# EAGLE board Resistor_Resistor (EAGLE 8.3.0), part 5 of 32
## Placement (x,y rotation side) (continued)
R5244  10K  [0201]  57.05,27.48 0 top
R5245  10K  [0201]  57.05,28.09 0 top
R5246  10K  [0201]  57.05,28.7 0 top
R5247  10K  [0201]  57.05,29.31 0 top
R5248  10K  [0201]  57.05,29.92 0 top
R5249  10K  [0201]  57.05,30.53 0 top
R5250  10K  [0201]  57.05,31.14 0 top
R5251  10K  [0201]  57.05,31.75 0 top
R5252  10K  [0201]  57.05,32.36 0 top
R5253  10K  [0201]  57.05,32.97 0 top
R5254  10K  [0201]  57.05,33.58 0 top
R5255  10K  [0201]  57.05,34.19 0 top
R5256  10K  [0201]  57.05,34.8 0 top
R5257  10K  [0201]  57.05,35.41 0 top
R5258  10K  [0201]  57.05,36.02 0 top
R5259  10K  [0201]  57.05,36.63 0 top
R5260  10K  [0201]  57.05,37.24 0 top
R5261  10K  [0201]  57.05,37.85 0 top
R5262  10K  [0201]  57.05,38.46 0 top
R5263  10K  [0201]  57.05,39.07 0 top
R5264  10K  [0201]  57.05,39.67 0 top
R5265  10K  [0201]  57.05,40.28 0 top
R5266  10K  [0201]  57.05,40.89 0 top
R5267  10K  [0201]  57.05,41.5 0 top
R5268  10K  [0201]  57.05,42.11 0 top
R5269  10K  [0201]  57.05,42.72 0 top
R5270  10K  [0201]  57.05,43.33 0 top
R5271  10K  [0201]  57.05,43.94 0 top
R5272  10K  [0201]  57.05,44.55 0 top
R5273  10K  [0201]  57.05,45.16 0 top
R5274  10K  [0201]  57.05,45.77 0 top
R5275  10K  [0201]  57.05,46.38 0 top
R5276  10K  [0201]  57.05,46.99 0 top
R5277  10K  [0201]  57.05,47.6 0 top
R5278  10K  [0201]  57.05,48.21 0 top
R5279  10K  [0201]  57.05,48.82 0 top
R5280  10K  [0201]  57.05,49.43 0 top
R5281  10K  [0201]  57.05,50.04 0 top
R5282  10K  [0201]  57.05,50.65 0 top
R5283  10K  [0201]  57.05,51.26 0 top
R5284  10K  [0201]  57.05,51.87 0 top
R5285  10K  [0201]  57.05,52.48 0 top
R5286  10K  [0201]  57.05,53.09 0 top
R5287  10K  [0201]  57.05,53.7 0 top
R5288  10K  [0201]  57.05,54.31 0 top
R5289  10K  [0201]  57.05,54.91 0 top
R5290  10K  [0201]  57.05,55.52 0 top
R5291  10K  [0201]  57.05,56.13 0 top
R5292  10K  [0201]  57.05,56.74 0 top
R5293  10K  [0201]  57.05,57.35 0 top
R5294  10K  [0201]  57.05,57.96 0 top
R5295  10K  [0201]  57.05,58.57 0 top
R5296  10K  [0201]  57.05,59.18 0 top
R5297  10K  [0201]  57.05,59.79 0 top
R5298  10K  [0201]  57.05,60.4 0 top
R5299  10K  [0201]  57.05,61.01 0 top
R5300  10K  [0201]  57.05,61.62 0 top
R5301  10K  [0201]  57.05,62.23 0 top
R5302  10K  [0201]  57.05,62.84 0 top
R5303  10K  [0201]  57.05,63.45 0 top
R5304  10K  [0201]  57.05,64.06 0 top
R5305  10K  [0201]  57.05,64.67 0 top
R5306  10K  [0201]  57.05,65.28 0 top
R5307  10K  [0201]  57.05,65.89 0 top
R5308  10K  [0201]  57.05,66.5 0 top
R5309  10K  [0201]  57.05,67.11 0 top
R5310  10K  [0201]  57.05,67.72 0 top
R5311  10K  [0201]  57.05,68.33 0 top
R5312  10K  [0201]  57.05,68.94 0 top
R5313  10K  [0201]  57.05,69.55 0 top
R5314  10K  [0201]  57.05,70.15 0 top
R5315  10K  [0201]  57.05,70.76 0 top
R5316  10K  [0201]  57.05,71.37 0 top
R5317  10K  [0201]  57.05,71.98 0 top
R5318  10K  [0201]  57.05,72.59 0 top
R5319  10K  [0201]  57.05,73.2 0 top
R5320  10K  [0201]  57.05,73.81 0 top
R5321  10K  [0201]  57.05,74.42 0 top
R5322  10K  [0201]  57.05,75.03 0 top
R5323  10K  [0201]  57.05,75.64 0 top
R5324  10K  [0201]  57.05,76.25 0 top
R5325  10K  [0201]  57.05,76.86 0 top
R5326  10K  [0201]  57.05,77.47 0 top
R5327  10K  [0201]  57.05,78.08 0 top
R5328  10K  [0201]  57.05,78.69 0 top
R5329  10K  [0201]  57.05,79.3 0 top
R5330  10K  [0201]  57.05,79.91 0 top
R5331  10K  [0201]  57.05,80.52 0 top
R5332  10K  [0201]  57.05,81.13 0 top
R5333  10K  [0201]  57.05,81.74 0 top
R5334  10K  [0201]  57.05,82.35 0 top
R5335  10K  [0201]  57.05,82.96 0 top
R5336  10K  [0201]  57.05,83.57 0 top
R5337  10K  [0201]  57.05,84.18 0 top
R5338  10K  [0201]  57.05,84.79 0 top
R5339  10K  [0201]  57.05,85.39 0 top
R5340  10K  [0201]  57.05,86 0 top
R5341  10K  [0201]  57.05,86.61 0 top
R5342  10K  [0201]  57.05,87.22 0 top
R5343  10K  [0201]  57.05,87.83 0 top
R5344  10K  [0201]  57.05,88.44 0 top
R5345  10K  [0201]  57.05,89.05 0 top
R5346  10K  [0201]  57.05,89.66 0 top
R5347  10K  [0201]  57.05,90.27 0 top
R5348  10K  [0201]  57.05,90.88 0 top
R5349  10K  [0201]  57.05,91.49 0 top
R5350  10K  [0201]  57.05,92.1 0 top
R5351  10K  [0201]  57.05,92.71 0 top
R5352  10K  [0201]  57.05,93.32 0 top
R5353  10K  [0201]  57.05,93.93 0 top
R5354  10K  [0201]  57.05,94.54 0 top
R5355  10K  [0201]  57.05,95.15 0 top
R5356  10K  [0201]  57.05,95.76 0 top
R5357  10K  [0201]  57.05,96.37 0 top
R5358  10K  [0201]  57.05,96.98 0 top
R5359  10K  [0201]  57.05,97.59 0 top
R5360  10K  [0201]  57.05,98.2 0 top
R5361  10K  [0201]  57.05,98.81 0 top
R5362  10K  [0201]  57.05,99.42 0 top
R5363  10K  [0201]  57.05,100.03 0 top
R5364  10K  [0201]  57.05,100.63 0 top
R5365  10K  [0201]  57.05,101.24 0 top
R5366  10K  [0201]  57.05,101.85 0 top
R5367  10K  [0201]  57.05,102.46 0 top
R5368  10K  [0201]  57.05,103.07 0 top
R5369  10K  [0201]  57.05,103.68 0 top
R5370  10K  [0201]  57.05,104.29 0 top
R5371  10K  [0201]  57.05,104.9 0 top
R5372  10K  [0201]  57.05,105.51 0 top
R5373  10K  [0201]  57.05,106.12 0 top
R5374  10K  [0201]  57.05,106.73 0 top
R5375  10K  [0201]  57.05,107.34 0 top
R5376  10K  [0201]  57.05,107.95 0 top
R5377  10K  [0201]  57.05,108.56 0 top
R5378  10K  [0201]  57.05,109.17 0 top
R5379  10K  [0201]  57.05,109.78 0 top
R5380  10K  [0201]  57.05,110.39 0 top
R5381  10K  [0201]  57.05,111 0 top
R5382  10K  [0201]  57.05,111.61 0 top
R5383  10K  [0201]  57.05,112.22 0 top
R5384  10K  [0201]  57.05,112.83 0 top
R5385  10K  [0201]  57.05,113.44 0 top
R5386  10K  [0201]  57.05,114.05 0 top
R5387  10K  [0201]  57.05,114.66 0 top
R5388  10K  [0201]  57.05,115.27 0 top
R5389  10K  [0201]  57.05,115.87 0 top
R5390  10K  [0201]  57.05,116.48 0 top
R5391  10K  [0201]  57.05,117.09 0 top
R5392  10K  [0201]  57.05,117.7 0 top
R5393  10K  [0201]  57.05,118.31 0 top
R5394  10K  [0201]  57.05,118.92 0 top
R5395  10K  [0201]  57.05,119.53 0 top
R5396  10K  [0201]  57.05,120.14 0 top
R5397  10K  [0201]  57.05,120.75 0 top
R5398  10K  [0201]  57.05,121.36 0 top
R5399  10K  [0201]  57.05,121.97 0 top
R5400  10K  [0201]  57.05,122.58 0 top
R5401  10K  [0201]  58.27,1.27 0 top
R5402  10K  [0201]  58.27,1.88 0 top
R5403  10K  [0201]  58.27,2.49 0 top
R5404  10K  [0201]  58.27,3.1 0 top
R5405  10K  [0201]  58.27,3.71 0 top
R5406  10K  [0201]  58.27,4.32 0 top
R5407  10K  [0201]  58.27,4.93 0 top
R5408  10K  [0201]  58.27,5.54 0 top
R5409  10K  [0201]  58.27,6.15 0 top
R5410  10K  [0201]  58.27,6.76 0 top
R5411  10K  [0201]  58.27,7.37 0 top
R5412  10K  [0201]  58.27,7.98 0 top
R5413  10K  [0201]  58.27,8.59 0 top
R5414  10K  [0201]  58.27,9.19 0 top
R5415  10K  [0201]  58.27,9.8 0 top
R5416  10K  [0201]  58.27,10.41 0 top
R5417  10K  [0201]  58.27,11.02 0 top
R5418  10K  [0201]  58.27,11.63 0 top
R5419  10K  [0201]  58.27,12.24 0 top
R5420  10K  [0201]  58.27,12.85 0 top
R5421  10K  [0201]  58.27,13.46 0 top
R5422  10K  [0201]  58.27,14.07 0 top
R5423  10K  [0201]  58.27,14.68 0 top
R5424  10K  [0201]  58.27,15.29 0 top
R5425  10K  [0201]  58.27,15.9 0 top
R5426  10K  [0201]  58.27,16.51 0 top
R5427  10K  [0201]  58.27,17.12 0 top
R5428  10K  [0201]  58.27,17.73 0 top
R5429  10K  [0201]  58.27,18.34 0 top
R5430  10K  [0201]  58.27,18.95 0 top
R5431  10K  [0201]  58.27,19.56 0 top
R5432  10K  [0201]  58.27,20.17 0 top
R5433  10K  [0201]  58.27,20.78 0 top
R5434  10K  [0201]  58.27,21.39 0 top
R5435  10K  [0201]  58.27,22 0 top
R5436  10K  [0201]  58.27,22.61 0 top
R5437  10K  [0201]  58.27,23.22 0 top
R5438  10K  [0201]  58.27,23.83 0 top
R5439  10K  [0201]  58.27,24.43 0 top
R5440  10K  [0201]  58.27,25.04 0 top
R5441  10K  [0201]  58.27,25.65 0 top
R5442  10K  [0201]  58.27,26.26 0 top
R5443  10K  [0201]  58.27,26.87 0 top
R5444  10K  [0201]  58.27,27.48 0 top
R5445  10K  [0201]  58.27,28.09 0 top
R5446  10K  [0201]  58.27,28.7 0 top
R5447  10K  [0201]  58.27,29.31 0 top
R5448  10K  [0201]  58.27,29.92 0 top
R5449  10K  [0201]  58.27,30.53 0 top
R5450  10K  [0201]  58.27,31.14 0 top
R5451  10K  [0201]  58.27,31.75 0 top
R5452  10K  [0201]  58.27,32.36 0 top
R5453  10K  [0201]  58.27,32.97 0 top
R5454  10K  [0201]  58.27,33.58 0 top
R5455  10K  [0201]  58.27,34.19 0 top
R5456  10K  [0201]  58.27,34.8 0 top
R5457  10K  [0201]  58.27,35.41 0 top
R5458  10K  [0201]  58.27,36.02 0 top
R5459  10K  [0201]  58.27,36.63 0 top
R5460  10K  [0201]  58.27,37.24 0 top
R5461  10K  [0201]  58.27,37.85 0 top
R5462  10K  [0201]  58.27,38.46 0 top
R5463  10K  [0201]  58.27,39.07 0 top
R5464  10K  [0201]  58.27,39.67 0 top
R5465  10K  [0201]  58.27,40.28 0 top
R5466  10K  [0201]  58.27,40.89 0 top
R5467  10K  [0201]  58.27,41.5 0 top
R5468  10K  [0201]  58.27,42.11 0 top
R5469  10K  [0201]  58.27,42.72 0 top
R5470  10K  [0201]  58.27,43.33 0 top
R5471  10K  [0201]  58.27,43.94 0 top
R5472  10K  [0201]  58.27,44.55 0 top
R5473  10K  [0201]  58.27,45.16 0 top
R5474  10K  [0201]  58.27,45.77 0 top
R5475  10K  [0201]  58.27,46.38 0 top
R5476  10K  [0201]  58.27,46.99 0 top
R5477  10K  [0201]  58.27,47.6 0 top
R5478  10K  [0201]  58.27,48.21 0 top
R5479  10K  [0201]  58.27,48.82 0 top
R5480  10K  [0201]  58.27,49.43 0 top
R5481  10K  [0201]  58.27,50.04 0 top
R5482  10K  [0201]  58.27,50.65 0 top
R5483  10K  [0201]  58.27,51.26 0 top
R5484  10K  [0201]  58.27,51.87 0 top
R5485  10K  [0201]  58.27,52.48 0 top
R5486  10K  [0201]  58.27,53.09 0 top
R5487  10K  [0201]  58.27,53.7 0 top
R5488  10K  [0201]  58.27,54.31 0 top
R5489  10K  [0201]  58.27,54.91 0 top
R5490  10K  [0201]  58.27,55.52 0 top
R5491  10K  [0201]  58.27,56.13 0 top
R5492  10K  [0201]  58.27,56.74 0 top
R5493  10K  [0201]  58.27,57.35 0 top
R5494  10K  [0201]  58.27,57.96 0 top
R5495  10K  [0201]  58.27,58.57 0 top
R5496  10K  [0201]  58.27,59.18 0 top
R5497  10K  [0201]  58.27,59.79 0 top
R5498  10K  [0201]  58.27,60.4 0 top
R5499  10K  [0201]  58.27,61.01 0 top
R5500  10K  [0201]  58.27,61.62 0 top
R5501  10K  [0201]  58.27,62.23 0 top
R5502  10K  [0201]  58.27,62.84 0 top
R5503  10K  [0201]  58.27,63.45 0 top
R5504  10K  [0201]  58.27,64.06 0 top
R5505  10K  [0201]  58.27,64.67 0 top
R5506  10K  [0201]  58.27,65.28 0 top
R5507  10K  [0201]  58.27,65.89 0 top
R5508  10K  [0201]  58.27,66.5 0 top
R5509  10K  [0201]  58.27,67.11 0 top
R5510  10K  [0201]  58.27,67.72 0 top
R5511  10K  [0201]  58.27,68.33 0 top
R5512  10K  [0201]  58.27,68.94 0 top
R5513  10K  [0201]  58.27,69.55 0 top
R5514  10K  [0201]  58.27,70.15 0 top
R5515  10K  [0201]  58.27,70.76 0 top
R5516  10K  [0201]  58.27,71.37 0 top
R5517  10K  [0201]  58.27,71.98 0 top
R5518  10K  [0201]  58.27,72.59 0 top
R5519  10K  [0201]  58.27,73.2 0 top
R5520  10K  [0201]  58.27,73.81 0 top
R5521  10K  [0201]  58.27,74.42 0 top
R5522  10K  [0201]  58.27,75.03 0 top
R5523  10K  [0201]  58.27,75.64 0 top
R5524  10K  [0201]  58.27,76.25 0 top
R5525  10K  [0201]  58.27,76.86 0 top
R5526  10K  [0201]  58.27,77.47 0 top
R5527  10K  [0201]  58.27,78.08 0 top
R5528  10K  [0201]  58.27,78.69 0 top
R5529  10K  [0201]  58.27,79.3 0 top
R5530  10K  [0201]  58.27,79.91 0 top
R5531  10K  [0201]  58.27,80.52 0 top
R5532  10K  [0201]  58.27,81.13 0 top
R5533  10K  [0201]  58.27,81.74 0 top
R5534  10K  [0201]  58.27,82.35 0 top
R5535  10K  [0201]  58.27,82.96 0 top
R5536  10K  [0201]  58.27,83.57 0 top
R5537  10K  [0201]  58.27,84.18 0 top
R5538  10K  [0201]  58.27,84.79 0 top
R5539  10K  [0201]  58.27,85.39 0 top
R5540  10K  [0201]  58.27,86 0 top
R5541  10K  [0201]  58.27,86.61 0 top
R5542  10K  [0201]  58.27,87.22 0 top
R5543  10K  [0201]  58.27,87.83 0 top
R5544  10K  [0201]  58.27,88.44 0 top
R5545  10K  [0201]  58.27,89.05 0 top
R5546  10K  [0201]  58.27,89.66 0 top
R5547  10K  [0201]  58.27,90.27 0 top
R5548  10K  [0201]  58.27,90.88 0 top
R5549  10K  [0201]  58.27,91.49 0 top
R5550  10K  [0201]  58.27,92.1 0 top
R5551  10K  [0201]  58.27,92.71 0 top
R5552  10K  [0201]  58.27,93.32 0 top
R5553  10K  [0201]  58.27,93.93 0 top
R5554  10K  [0201]  58.27,94.54 0 top
R5555  10K  [0201]  58.27,95.15 0 top
R5556  10K  [0201]  58.27,95.76 0 top
R5557  10K  [0201]  58.27,96.37 0 top
R5558  10K  [0201]  58.27,96.98 0 top
R5559  10K  [0201]  58.27,97.59 0 top
R5560  10K  [0201]  58.27,98.2 0 top
R5561  10K  [0201]  58.27,98.81 0 top
R5562  10K  [0201]  58.27,99.42 0 top
R5563  10K  [0201]  58.27,100.03 0 top
R5564  10K  [0201]  58.27,100.63 0 top
R5565  10K  [0201]  58.27,101.24 0 top
R5566  10K  [0201]  58.27,101.85 0 top
R5567  10K  [0201]  58.27,102.46 0 top
R5568  10K  [0201]  58.27,103.07 0 top
R5569  10K  [0201]  58.27,103.68 0 top
R5570  10K  [0201]  58.27,104.29 0 top
R5571  10K  [0201]  58.27,104.9 0 top
R5572  10K  [0201]  58.27,105.51 0 top
R5573  10K  [0201]  58.27,106.12 0 top
R5574  10K  [0201]  58.27,106.73 0 top
R5575  10K  [0201]  58.27,107.34 0 top
R5576  10K  [0201]  58.27,107.95 0 top
R5577  10K  [0201]  58.27,108.56 0 top
R5578  10K  [0201]  58.27,109.17 0 top
R5579  10K  [0201]  58.27,109.78 0 top
R5580  10K  [0201]  58.27,110.39 0 top
R5581  10K  [0201]  58.27,111 0 top
R5582  10K  [0201]  58.27,111.61 0 top
R5583  10K  [0201]  58.27,112.22 0 top
R5584  10K  [0201]  58.27,112.83 0 top
R5585  10K  [0201]  58.27,113.44 0 top
R5586  10K  [0201]  58.27,114.05 0 top
R5587  10K  [0201]  58.27,114.66 0 top
R5588  10K  [0201]  58.27,115.27 0 top
R5589  10K  [0201]  58.27,115.87 0 top
R5590  10K  [0201]  58.27,116.48 0 top
R5591  10K  [0201]  58.27,117.09 0 top
R5592  10K  [0201]  58.27,117.7 0 top
R5593  10K  [0201]  58.27,118.31 0 top
R5594  10K  [0201]  58.27,118.92 0 top
R5595  10K  [0201]  58.27,119.53 0 top
R5596  10K  [0201]  58.27,120.14 0 top
R5597  10K  [0201]  58.27,120.75 0 top
R5598  10K  [0201]  58.27,121.36 0 top
R5599  10K  [0201]  58.27,121.97 0 top
R5600  10K  [0201]  58.27,122.58 0 top
R5601  10K  [0201]  59.49,1.27 0 top
R5602  10K  [0201]  59.49,1.88 0 top
R5603  10K  [0201]  59.49,2.49 0 top
R5604  10K  [0201]  59.49,3.1 0 top
R5605  10K  [0201]  59.49,3.71 0 top
R5606  10K  [0201]  59.49,4.32 0 top
R5607  10K  [0201]  59.49,4.93 0 top
R5608  10K  [0201]  59.49,5.54 0 top
R5609  10K  [0201]  59.49,6.15 0 top
R5610  10K  [0201]  59.49,6.76 0 top
R5611  10K  [0201]  59.49,7.37 0 top
R5612  10K  [0201]  59.49,7.98 0 top
R5613  10K  [0201]  59.49,8.59 0 top
R5614  10K  [0201]  59.49,9.19 0 top
R5615  10K  [0201]  59.49,9.8 0 top
R5616  10K  [0201]  59.49,10.41 0 top
R5617  10K  [0201]  59.49,11.02 0 top
R5618  10K  [0201]  59.49,11.63 0 top
R5619  10K  [0201]  59.49,12.24 0 top
R5620  10K  [0201]  59.49,12.85 0 top
R5621  10K  [0201]  59.49,13.46 0 top
R5622  10K  [0201]  59.49,14.07 0 top
R5623  10K  [0201]  59.49,14.68 0 top
R5624  10K  [0201]  59.49,15.29 0 top
R5625  10K  [0201]  59.49,15.9 0 top
R5626  10K  [0201]  59.49,16.51 0 top
R5627  10K  [0201]  59.49,17.12 0 top
R5628  10K  [0201]  59.49,17.73 0 top
R5629  10K  [0201]  59.49,18.34 0 top
R5630  10K  [0201]  59.49,18.95 0 top
R5631  10K  [0201]  59.49,19.56 0 top
R5632  10K  [0201]  59.49,20.17 0 top
R5633  10K  [0201]  59.49,20.78 0 top
R5634  10K  [0201]  59.49,21.39 0 top
R5635  10K  [0201]  59.49,22 0 top
R5636  10K  [0201]  59.49,22.61 0 top
R5637  10K  [0201]  59.49,23.22 0 top
R5638  10K  [0201]  59.49,23.83 0 top
R5639  10K  [0201]  59.49,24.43 0 top
R5640  10K  [0201]  59.49,25.04 0 top
R5641  10K  [0201]  59.49,25.65 0 top
R5642  10K  [0201]  59.49,26.26 0 top
R5643  10K  [0201]  59.49,26.87 0 top
R5644  10K  [0201]  59.49,27.48 0 top
R5645  10K  [0201]  59.49,28.09 0 top
R5646  10K  [0201]  59.49,28.7 0 top
R5647  10K  [0201]  59.49,29.31 0 top
R5648  10K  [0201]  59.49,29.92 0 top
R5649  10K  [0201]  59.49,30.53 0 top
R5650  10K  [0201]  59.49,31.14 0 top
R5651  10K  [0201]  59.49,31.75 0 top
R5652  10K  [0201]  59.49,32.36 0 top
R5653  10K  [0201]  59.49,32.97 0 top
R5654  10K  [0201]  59.49,33.58 0 top
R5655  10K  [0201]  59.49,34.19 0 top
R5656  10K  [0201]  59.49,34.8 0 top
R5657  10K  [0201]  59.49,35.41 0 top
R5658  10K  [0201]  59.49,36.02 0 top
R5659  10K  [0201]  59.49,36.63 0 top
R5660  10K  [0201]  59.49,37.24 0 top
R5661  10K  [0201]  59.49,37.85 0 top
R5662  10K  [0201]  59.49,38.46 0 top
R5663  10K  [0201]  59.49,39.07 0 top
R5664  10K  [0201]  59.49,39.67 0 top
R5665  10K  [0201]  59.49,40.28 0 top
R5666  10K  [0201]  59.49,40.89 0 top
R5667  10K  [0201]  59.49,41.5 0 top
R5668  10K  [0201]  59.49,42.11 0 top
R5669  10K  [0201]  59.49,42.72 0 top
R5670  10K  [0201]  59.49,43.33 0 top
R5671  10K  [0201]  59.49,43.94 0 top
R5672  10K  [0201]  59.49,44.55 0 top
R5673  10K  [0201]  59.49,45.16 0 top
R5674  10K  [0201]  59.49,45.77 0 top
R5675  10K  [0201]  59.49,46.38 0 top
R5676  10K  [0201]  59.49,46.99 0 top
R5677  10K  [0201]  59.49,47.6 0 top
R5678  10K  [0201]  59.49,48.21 0 top
R5679  10K  [0201]  59.49,48.82 0 top
R5680  10K  [0201]  59.49,49.43 0 top
R5681  10K  [0201]  59.49,50.04 0 top
R5682  10K  [0201]  59.49,50.65 0 top
R5683  10K  [0201]  59.49,51.26 0 top
R5684  10K  [0201]  59.49,51.87 0 top
R5685  10K  [0201]  59.49,52.48 0 top
R5686  10K  [0201]  59.49,53.09 0 top
R5687  10K  [0201]  59.49,53.7 0 top
R5688  10K  [0201]  59.49,54.31 0 top
R5689  10K  [0201]  59.49,54.91 0 top
R5690  10K  [0201]  59.49,55.52 0 top
R5691  10K  [0201]  59.49,56.13 0 top
R5692  10K  [0201]  59.49,56.74 0 top
R5693  10K  [0201]  59.49,57.35 0 top
R5694  10K  [0201]  59.49,57.96 0 top
R5695  10K  [0201]  59.49,58.57 0 top
R5696  10K  [0201]  59.49,59.18 0 top
R5697  10K  [0201]  59.49,59.79 0 top
R5698  10K  [0201]  59.49,60.4 0 top
R5699  10K  [0201]  59.49,61.01 0 top
R5700  10K  [0201]  59.49,61.62 0 top
R5701  10K  [0201]  59.49,62.23 0 top
R5702  10K  [0201]  59.49,62.84 0 top
R5703  10K  [0201]  59.49,63.45 0 top
R5704  10K  [0201]  59.49,64.06 0 top
R5705  10K  [0201]  59.49,64.67 0 top
R5706  10K  [0201]  59.49,65.28 0 top
R5707  10K  [0201]  59.49,65.89 0 top
R5708  10K  [0201]  59.49,66.5 0 top
R5709  10K  [0201]  59.49,67.11 0 top
R5710  10K  [0201]  59.49,67.72 0 top
R5711  10K  [0201]  59.49,68.33 0 top
R5712  10K  [0201]  59.49,68.94 0 top
R5713  10K  [0201]  59.49,69.55 0 top
R5714  10K  [0201]  59.49,70.15 0 top
R5715  10K  [0201]  59.49,70.76 0 top
R5716  10K  [0201]  59.49,71.37 0 top
R5717  10K  [0201]  59.49,71.98 0 top
R5718  10K  [0201]  59.49,72.59 0 top
R5719  10K  [0201]  59.49,73.2 0 top
R5720  10K  [0201]  59.49,73.81 0 top
R5721  10K  [0201]  59.49,74.42 0 top
R5722  10K  [0201]  59.49,75.03 0 top
R5723  10K  [0201]  59.49,75.64 0 top
R5724  10K  [0201]  59.49,76.25 0 top
R5725  10K  [0201]  59.49,76.86 0 top
R5726  10K  [0201]  59.49,77.47 0 top
R5727  10K  [0201]  59.49,78.08 0 top
R5728  10K  [0201]  59.49,78.69 0 top
R5729  10K  [0201]  59.49,79.3 0 top
R5730  10K  [0201]  59.49,79.91 0 top
R5731  10K  [0201]  59.49,80.52 0 top
R5732  10K  [0201]  59.49,81.13 0 top
R5733  10K  [0201]  59.49,81.74 0 top
R5734  10K  [0201]  59.49,82.35 0 top
R5735  10K  [0201]  59.49,82.96 0 top
R5736  10K  [0201]  59.49,83.57 0 top
R5737  10K  [0201]  59.49,84.18 0 top
R5738  10K  [0201]  59.49,84.79 0 top
R5739  10K  [0201]  59.49,85.39 0 top
R5740  10K  [0201]  59.49,86 0 top
R5741  10K  [0201]  59.49,86.61 0 top
R5742  10K  [0201]  59.49,87.22 0 top
R5743  10K  [0201]  59.49,87.83 0 top
R5744  10K  [0201]  59.49,88.44 0 top
R5745  10K  [0201]  59.49,89.05 0 top
R5746  10K  [0201]  59.49,89.66 0 top
R5747  10K  [0201]  59.49,90.27 0 top
R5748  10K  [0201]  59.49,90.88 0 top
R5749  10K  [0201]  59.49,91.49 0 top
R5750  10K  [0201]  59.49,92.1 0 top
R5751  10K  [0201]  59.49,92.71 0 top
R5752  10K  [0201]  59.49,93.32 0 top
R5753  10K  [0201]  59.49,93.93 0 top
R5754  10K  [0201]  59.49,94.54 0 top
R5755  10K  [0201]  59.49,95.15 0 top
R5756  10K  [0201]  59.49,95.76 0 top
R5757  10K  [0201]  59.49,96.37 0 top
R5758  10K  [0201]  59.49,96.98 0 top
R5759  10K  [0201]  59.49,97.59 0 top
R5760  10K  [0201]  59.49,98.2 0 top
R5761  10K  [0201]  59.49,98.81 0 top
R5762  10K  [0201]  59.49,99.42 0 top
R5763  10K  [0201]  59.49,100.03 0 top
R5764  10K  [0201]  59.49,100.63 0 top
R5765  10K  [0201]  59.49,101.24 0 top
R5766  10K  [0201]  59.49,101.85 0 top
R5767  10K  [0201]  59.49,102.46 0 top
R5768  10K  [0201]  59.49,103.07 0 top
R5769  10K  [0201]  59.49,103.68 0 top
R5770  10K  [0201]  59.49,104.29 0 top
R5771  10K  [0201]  59.49,104.9 0 top
R5772  10K  [0201]  59.49,105.51 0 top
R5773  10K  [0201]  59.49,106.12 0 top
R5774  10K  [0201]  59.49,106.73 0 top
R5775  10K  [0201]  59.49,107.34 0 top
R5776  10K  [0201]  59.49,107.95 0 top
R5777  10K  [0201]  59.49,108.56 0 top
R5778  10K  [0201]  59.49,109.17 0 top
R5779  10K  [0201]  59.49,109.78 0 top
R5780  10K  [0201]  59.49,110.39 0 top
R5781  10K  [0201]  59.49,111 0 top
R5782  10K  [0201]  59.49,111.61 0 top
R5783  10K  [0201]  59.49,112.22 0 top
R5784  10K  [0201]  59.49,112.83 0 top
R5785  10K  [0201]  59.49,113.44 0 top
R5786  10K  [0201]  59.49,114.05 0 top
R5787  10K  [0201]  59.49,114.66 0 top
R5788  10K  [0201]  59.49,115.27 0 top
R5789  10K  [0201]  59.49,115.87 0 top
R5790  10K  [0201]  59.49,116.48 0 top
R5791  10K  [0201]  59.49,117.09 0 top
R5792  10K  [0201]  59.49,117.7 0 top
R5793  10K  [0201]  59.49,118.31 0 top
R5794  10K  [0201]  59.49,118.92 0 top
R5795  10K  [0201]  59.49,119.53 0 top
R5796  10K  [0201]  59.49,120.14 0 top
R5797  10K  [0201]  59.49,120.75 0 top
R5798  10K  [0201]  59.49,121.36 0 top
R5799  10K  [0201]  59.49,121.97 0 top
R5800  10K  [0201]  59.49,122.58 0 top
R5801  10K  [0201]  60.71,1.27 0 top
R5802  10K  [0201]  60.71,1.88 0 top
R5803  10K  [0201]  60.71,2.49 0 top
R5804  10K  [0201]  60.71,3.1 0 top
R5805  10K  [0201]  60.71,3.71 0 top
R5806  10K  [0201]  60.71,4.32 0 top
R5807  10K  [0201]  60.71,4.93 0 top
R5808  10K  [0201]  60.71,5.54 0 top
R5809  10K  [0201]  60.71,6.15 0 top
R5810  10K  [0201]  60.71,6.76 0 top
R5811  10K  [0201]  60.71,7.37 0 top
R5812  10K  [0201]  60.71,7.98 0 top
R5813  10K  [0201]  60.71,8.59 0 top
R5814  10K  [0201]  60.71,9.19 0 top
R5815  10K  [0201]  60.71,9.8 0 top
R5816  10K  [0201]  60.71,10.41 0 top
R5817  10K  [0201]  60.71,11.02 0 top
R5818  10K  [0201]  60.71,11.63 0 top
R5819  10K  [0201]  60.71,12.24 0 top
R5820  10K  [0201]  60.71,12.85 0 top
R5821  10K  [0201]  60.71,13.46 0 top
R5822  10K  [0201]  60.71,14.07 0 top
R5823  10K  [0201]  60.71,14.68 0 top
R5824  10K  [0201]  60.71,15.29 0 top
R5825  10K  [0201]  60.71,15.9 0 top
R5826  10K  [0201]  60.71,16.51 0 top
R5827  10K  [0201]  60.71,17.12 0 top
R5828  10K  [0201]  60.71,17.73 0 top
R5829  10K  [0201]  60.71,18.34 0 top
R5830  10K  [0201]  60.71,18.95 0 top
R5831  10K  [0201]  60.71,19.56 0 top
R5832  10K  [0201]  60.71,20.17 0 top
R5833  10K  [0201]  60.71,20.78 0 top
R5834  10K  [0201]  60.71,21.39 0 top
R5835  10K  [0201]  60.71,22 0 top
R5836  10K  [0201]  60.71,22.61 0 top
R5837  10K  [0201]  60.71,23.22 0 top
R5838  10K  [0201]  60.71,23.83 0 top
R5839  10K  [0201]  60.71,24.43 0 top
R5840  10K  [0201]  60.71,25.04 0 top
R5841  10K  [0201]  60.71,25.65 0 top
R5842  10K  [0201]  60.71,26.26 0 top
R5843  10K  [0201]  60.71,26.87 0 top
R5844  10K  [0201]  60.71,27.48 0 top
R5845  10K  [0201]  60.71,28.09 0 top
R5846  10K  [0201]  60.71,28.7 0 top
R5847  10K  [0201]  60.71,29.31 0 top
R5848  10K  [0201]  60.71,29.92 0 top
R5849  10K  [0201]  60.71,30.53 0 top
R5850  10K  [0201]  60.71,31.14 0 top
R5851  10K  [0201]  60.71,31.75 0 top
R5852  10K  [0201]  60.71,32.36 0 top
R5853  10K  [0201]  60.71,32.97 0 top
R5854  10K  [0201]  60.71,33.58 0 top
R5855  10K  [0201]  60.71,34.19 0 top
R5856  10K  [0201]  60.71,34.8 0 top
R5857  10K  [0201]  60.71,35.41 0 top
R5858  10K  [0201]  60.71,36.02 0 top
R5859  10K  [0201]  60.71,36.63 0 top
R5860  10K  [0201]  60.71,37.24 0 top
R5861  10K  [0201]  60.71,37.85 0 top
R5862  10K  [0201]  60.71,38.46 0 top
R5863  10K  [0201]  60.71,39.07 0 top
R5864  10K  [0201]  60.71,39.67 0 top
R5865  10K  [0201]  60.71,40.28 0 top
R5866  10K  [0201]  60.71,40.89 0 top
R5867  10K  [0201]  60.71,41.5 0 top
R5868  10K  [0201]  60.71,42.11 0 top
R5869  10K  [0201]  60.71,42.72 0 top
R5870  10K  [0201]  60.71,43.33 0 top
R5871  10K  [0201]  60.71,43.94 0 top
R5872  10K  [0201]  60.71,44.55 0 top
R5873  10K  [0201]  60.71,45.16 0 top
R5874  10K  [0201]  60.71,45.77 0 top
R5875  10K  [0201]  60.71,46.38 0 top
R5876  10K  [0201]  60.71,46.99 0 top
R5877  10K  [0201]  60.71,47.6 0 top
R5878  10K  [0201]  60.71,48.21 0 top
R5879  10K  [0201]  60.71,48.82 0 top
R5880  10K  [0201]  60.71,49.43 0 top
R5881  10K  [0201]  60.71,50.04 0 top
R5882  10K  [0201]  60.71,50.65 0 top
R5883  10K  [0201]  60.71,51.26 0 top
R5884  10K  [0201]  60.71,51.87 0 top
R5885  10K  [0201]  60.71,52.48 0 top
R5886  10K  [0201]  60.71,53.09 0 top
R5887  10K  [0201]  60.71,53.7 0 top
R5888  10K  [0201]  60.71,54.31 0 top
R5889  10K  [0201]  60.71,54.91 0 top
R5890  10K  [0201]  60.71,55.52 0 top
R5891  10K  [0201]  60.71,56.13 0 top
R5892  10K  [0201]  60.71,56.74 0 top
R5893  10K  [0201]  60.71,57.35 0 top
R5894  10K  [0201]  60.71,57.96 0 top
R5895  10K  [0201]  60.71,58.57 0 top
R5896  10K  [0201]  60.71,59.18 0 top
R5897  10K  [0201]  60.71,59.79 0 top
R5898  10K  [0201]  60.71,60.4 0 top
R5899  10K  [0201]  60.71,61.01 0 top
R5900  10K  [0201]  60.71,61.62 0 top
R5901  10K  [0201]  60.71,62.23 0 top
R5902  10K  [0201]  60.71,62.84 0 top
R5903  10K  [0201]  60.71,63.45 0 top
R5904  10K  [0201]  60.71,64.06 0 top
R5905  10K  [0201]  60.71,64.67 0 top
R5906  10K  [0201]  60.71,65.28 0 top
R5907  10K  [0201]  60.71,65.89 0 top
R5908  10K  [0201]  60.71,66.5 0 top
R5909  10K  [0201]  60.71,67.11 0 top
R5910  10K  [0201]  60.71,67.72 0 top
R5911  10K  [0201]  60.71,68.33 0 top
R5912  10K  [0201]  60.71,68.94 0 top
R5913  10K  [0201]  60.71,69.55 0 top
R5914  10K  [0201]  60.71,70.15 0 top
R5915  10K  [0201]  60.71,70.76 0 top
R5916  10K  [0201]  60.71,71.37 0 top
R5917  10K  [0201]  60.71,71.98 0 top
R5918  10K  [0201]  60.71,72.59 0 top
R5919  10K  [0201]  60.71,73.2 0 top
R5920  10K  [0201]  60.71,73.81 0 top
R5921  10K  [0201]  60.71,74.42 0 top
R5922  10K  [0201]  60.71,75.03 0 top
R5923  10K  [0201]  60.71,75.64 0 top
R5924  10K  [0201]  60.71,76.25 0 top
R5925  10K  [0201]  60.71,76.86 0 top
R5926  10K  [0201]  60.71,77.47 0 top
R5927  10K  [0201]  60.71,78.08 0 top
R5928  10K  [0201]  60.71,78.69 0 top
R5929  10K  [0201]  60.71,79.3 0 top
R5930  10K  [0201]  60.71,79.91 0 top
R5931  10K  [0201]  60.71,80.52 0 top
R5932  10K  [0201]  60.71,81.13 0 top
R5933  10K  [0201]  60.71,81.74 0 top
R5934  10K  [0201]  60.71,82.35 0 top
R5935  10K  [0201]  60.71,82.96 0 top
R5936  10K  [0201]  60.71,83.57 0 top
R5937  10K  [0201]  60.71,84.18 0 top
R5938  10K  [0201]  60.71,84.79 0 top
R5939  10K  [0201]  60.71,85.39 0 top
R5940  10K  [0201]  60.71,86 0 top
R5941  10K  [0201]  60.71,86.61 0 top
R5942  10K  [0201]  60.71,87.22 0 top
R5943  10K  [0201]  60.71,87.83 0 top
R5944  10K  [0201]  60.71,88.44 0 top
R5945  10K  [0201]  60.71,89.05 0 top
R5946  10K  [0201]  60.71,89.66 0 top
R5947  10K  [0201]  60.71,90.27 0 top
R5948  10K  [0201]  60.71,90.88 0 top
R5949  10K  [0201]  60.71,91.49 0 top
R5950  10K  [0201]  60.71,92.1 0 top
R5951  10K  [0201]  60.71,92.71 0 top
R5952  10K  [0201]  60.71,93.32 0 top
R5953  10K  [0201]  60.71,93.93 0 top
R5954  10K  [0201]  60.71,94.54 0 top
R5955  10K  [0201]  60.71,95.15 0 top
R5956  10K  [0201]  60.71,95.76 0 top
R5957  10K  [0201]  60.71,96.37 0 top
R5958  10K  [0201]  60.71,96.98 0 top
R5959  10K  [0201]  60.71,97.59 0 top
R5960  10K  [0201]  60.71,98.2 0 top
R5961  10K  [0201]  60.71,98.81 0 top
R5962  10K  [0201]  60.71,99.42 0 top
R5963  10K  [0201]  60.71,100.03 0 top
R5964  10K  [0201]  60.71,100.63 0 top
R5965  10K  [0201]  60.71,101.24 0 top
R5966  10K  [0201]  60.71,101.85 0 top
R5967  10K  [0201]  60.71,102.46 0 top
R5968  10K  [0201]  60.71,103.07 0 top
R5969  10K  [0201]  60.71,103.68 0 top
R5970  10K  [0201]  60.71,104.29 0 top
R5971  10K  [0201]  60.71,104.9 0 top
R5972  10K  [0201]  60.71,105.51 0 top
R5973  10K  [0201]  60.71,106.12 0 top
R5974  10K  [0201]  60.71,106.73 0 top
R5975  10K  [0201]  60.71,107.34 0 top
R5976  10K  [0201]  60.71,107.95 0 top
R5977  10K  [0201]  60.71,108.56 0 top
R5978  10K  [0201]  60.71,109.17 0 top
R5979  10K  [0201]  60.71,109.78 0 top
R5980  10K  [0201]  60.71,110.39 0 top
R5981  10K  [0201]  60.71,111 0 top
R5982  10K  [0201]  60.71,111.61 0 top
R5983  10K  [0201]  60.71,112.22 0 top
R5984  10K  [0201]  60.71,112.83 0 top
R5985  10K  [0201]  60.71,113.44 0 top
R5986  10K  [0201]  60.71,114.05 0 top
R5987  10K  [0201]  60.71,114.66 0 top
R5988  10K  [0201]  60.71,115.27 0 top
R5989  10K  [0201]  60.71,115.87 0 top
R5990  10K  [0201]  60.71,116.48 0 top
R5991  10K  [0201]  60.71,117.09 0 top
R5992  10K  [0201]  60.71,117.7 0 top
R5993  10K  [0201]  60.71,118.31 0 top
R5994  10K  [0201]  60.71,118.92 0 top
R5995  10K  [0201]  60.71,119.53 0 top
R5996  10K  [0201]  60.71,120.14 0 top
R5997  10K  [0201]  60.71,120.75 0 top
R5998  10K  [0201]  60.71,121.36 0 top
R5999  10K  [0201]  60.71,121.97 0 top
R6000  10K  [0201]  60.71,122.58 0 top
R6001  10K  [0201]  61.93,1.27 0 top
R6002  10K  [0201]  61.93,1.88 0 top
R6003  10K  [0201]  61.93,2.49 0 top
R6004  10K  [0201]  61.93,3.1 0 top
R6005  10K  [0201]  61.93,3.71 0 top
R6006  10K  [0201]  61.93,4.32 0 top
R6007  10K  [0201]  61.93,4.93 0 top
R6008  10K  [0201]  61.93,5.54 0 top
R6009  10K  [0201]  61.93,6.15 0 top
R6010  10K  [0201]  61.93,6.76 0 top
R6011  10K  [0201]  61.93,7.37 0 top
R6012  10K  [0201]  61.93,7.98 0 top
R6013  10K  [0201]  61.93,8.59 0 top
R6014  10K  [0201]  61.93,9.19 0 top
R6015  10K  [0201]  61.93,9.8 0 top
R6016  10K  [0201]  61.93,10.41 0 top
R6017  10K  [0201]  61.93,11.02 0 top
R6018  10K  [0201]  61.93,11.63 0 top
R6019  10K  [0201]  61.93,12.24 0 top
R6020  10K  [0201]  61.93,12.85 0 top
R6021  10K  [0201]  61.93,13.46 0 top
R6022  10K  [0201]  61.93,14.07 0 top
R6023  10K  [0201]  61.93,14.68 0 top
R6024  10K  [0201]  61.93,15.29 0 top
R6025  10K  [0201]  61.93,15.9 0 top
R6026  10K  [0201]  61.93,16.51 0 top
R6027  10K  [0201]  61.93,17.12 0 top
R6028  10K  [0201]  61.93,17.73 0 top
R6029  10K  [0201]  61.93,18.34 0 top
R6030  10K  [0201]  61.93,18.95 0 top
R6031  10K  [0201]  61.93,19.56 0 top
R6032  10K  [0201]  61.93,20.17 0 top
R6033  10K  [0201]  61.93,20.78 0 top
R6034  10K  [0201]  61.93,21.39 0 top
R6035  10K  [0201]  61.93,22 0 top
R6036  10K  [0201]  61.93,22.61 0 top
R6037  10K  [0201]  61.93,23.22 0 top
R6038  10K  [0201]  61.93,23.83 0 top
R6039  10K  [0201]  61.93,24.43 0 top
R6040  10K  [0201]  61.93,25.04 0 top
R6041  10K  [0201]  61.93,25.65 0 top
R6042  10K  [0201]  61.93,26.26 0 top
R6043  10K  [0201]  61.93,26.87 0 top
R6044  10K  [0201]  61.93,27.48 0 top
R6045  10K  [0201]  61.93,28.09 0 top
R6046  10K  [0201]  61.93,28.7 0 top
R6047  10K  [0201]  61.93,29.31 0 top
R6048  10K  [0201]  61.93,29.92 0 top
R6049  10K  [0201]  61.93,30.53 0 top
R6050  10K  [0201]  61.93,31.14 0 top
R6051  10K  [0201]  61.93,31.75 0 top
R6052  10K  [0201]  61.93,32.36 0 top
R6053  10K  [0201]  61.93,32.97 0 top
R6054  10K  [0201]  61.93,33.58 0 top
R6055  10K  [0201]  61.93,34.19 0 top
R6056  10K  [0201]  61.93,34.8 0 top
R6057  10K  [0201]  61.93,35.41 0 top
R6058  10K  [0201]  61.93,36.02 0 top
R6059  10K  [0201]  61.93,36.63 0 top
R6060  10K  [0201]  61.93,37.24 0 top
R6061  10K  [0201]  61.93,37.85 0 top
R6062  10K  [0201]  61.93,38.46 0 top
R6063  10K  [0201]  61.93,39.07 0 top
R6064  10K  [0201]  61.93,39.67 0 top
R6065  10K  [0201]  61.93,40.28 0 top
R6066  10K  [0201]  61.93,40.89 0 top
R6067  10K  [0201]  61.93,41.5 0 top
R6068  10K  [0201]  61.93,42.11 0 top
R6069  10K  [0201]  61.93,42.72 0 top
R6070  10K  [0201]  61.93,43.33 0 top
R6071  10K  [0201]  61.93,43.94 0 top
R6072  10K  [0201]  61.93,44.55 0 top
R6073  10K  [0201]  61.93,45.16 0 top
R6074  10K  [0201]  61.93,45.77 0 top
R6075  10K  [0201]  61.93,46.38 0 top
R6076  10K  [0201]  61.93,46.99 0 top
R6077  10K  [0201]  61.93,47.6 0 top
R6078  10K  [0201]  61.93,48.21 0 top
R6079  10K  [0201]  61.93,48.82 0 top
R6080  10K  [0201]  61.93,49.43 0 top
R6081  10K  [0201]  61.93,50.04 0 top
R6082  10K  [0201]  61.93,50.65 0 top
R6083  10K  [0201]  61.93,51.26 0 top
R6084  10K  [0201]  61.93,51.87 0 top
R6085  10K  [0201]  61.93,52.48 0 top
R6086  10K  [0201]  61.93,53.09 0 top
R6087  10K  [0201]  61.93,53.7 0 top
R6088  10K  [0201]  61.93,54.31 0 top
R6089  10K  [0201]  61.93,54.91 0 top
R6090  10K  [0201]  61.93,55.52 0 top
R6091  10K  [0201]  61.93,56.13 0 top
R6092  10K  [0201]  61.93,56.74 0 top
R6093  10K  [0201]  61.93,57.35 0 top
R6094  10K  [0201]  61.93,57.96 0 top
R6095  10K  [0201]  61.93,58.57 0 top
R6096  10K  [0201]  61.93,59.18 0 top
R6097  10K  [0201]  61.93,59.79 0 top
R6098  10K  [0201]  61.93,60.4 0 top
R6099  10K  [0201]  61.93,61.01 0 top
R6100  10K  [0201]  61.93,61.62 0 top
R6101  10K  [0201]  61.93,62.23 0 top
R6102  10K  [0201]  61.93,62.84 0 top
R6103  10K  [0201]  61.93,63.45 0 top
R6104  10K  [0201]  61.93,64.06 0 top
R6105  10K  [0201]  61.93,64.67 0 top
R6106  10K  [0201]  61.93,65.28 0 top
R6107  10K  [0201]  61.93,65.89 0 top
R6108  10K  [0201]  61.93,66.5 0 top
R6109  10K  [0201]  61.93,67.11 0 top
R6110  10K  [0201]  61.93,67.72 0 top
R6111  10K  [0201]  61.93,68.33 0 top
R6112  10K  [0201]  61.93,68.94 0 top
R6113  10K  [0201]  61.93,69.55 0 top
R6114  10K  [0201]  61.93,70.15 0 top
R6115  10K  [0201]  61.93,70.76 0 top
R6116  10K  [0201]  61.93,71.37 0 top
R6117  10K  [0201]  61.93,71.98 0 top
R6118  10K  [0201]  61.93,72.59 0 top
R6119  10K  [0201]  61.93,73.2 0 top
R6120  10K  [0201]  61.93,73.81 0 top
R6121  10K  [0201]  61.93,74.42 0 top
R6122  10K  [0201]  61.93,75.03 0 top
R6123  10K  [0201]  61.93,75.64 0 top
R6124  10K  [0201]  61.93,76.25 0 top
R6125  10K  [0201]  61.93,76.86 0 top
R6126  10K  [0201]  61.93,77.47 0 top
R6127  10K  [0201]  61.93,78.08 0 top
R6128  10K  [0201]  61.93,78.69 0 top
R6129  10K  [0201]  61.93,79.3 0 top
R6130  10K  [0201]  61.93,79.91 0 top
R6131  10K  [0201]  61.93,80.52 0 top
R6132  10K  [0201]  61.93,81.13 0 top
R6133  10K  [0201]  61.93,81.74 0 top
R6134  10K  [0201]  61.93,82.35 0 top
R6135  10K  [0201]  61.93,82.96 0 top
R6136  10K  [0201]  61.93,83.57 0 top
R6137  10K  [0201]  61.93,84.18 0 top
R6138  10K  [0201]  61.93,84.79 0 top
R6139  10K  [0201]  61.93,85.39 0 top
R6140  10K  [0201]  61.93,86 0 top
R6141  10K  [0201]  61.93,86.61 0 top
R6142  10K  [0201]  61.93,87.22 0 top
R6143  10K  [0201]  61.93,87.83 0 top
R6144  10K  [0201]  61.93,88.44 0 top
R6145  10K  [0201]  61.93,89.05 0 top
R6146  10K  [0201]  61.93,89.66 0 top
R6147  10K  [0201]  61.93,90.27 0 top
R6148  10K  [0201]  61.93,90.88 0 top
R6149  10K  [0201]  61.93,91.49 0 top
R6150  10K  [0201]  61.93,92.1 0 top
R6151  10K  [0201]  61.93,92.71 0 top
R6152  10K  [0201]  61.93,93.32 0 top
R6153  10K  [0201]  61.93,93.93 0 top
R6154  10K  [0201]  61.93,94.54 0 top
R6155  10K  [0201]  61.93,95.15 0 top
R6156  10K  [0201]  61.93,95.76 0 top
R6157  10K  [0201]  61.93,96.37 0 top
R6158  10K  [0201]  61.93,96.98 0 top
R6159  10K  [0201]  61.93,97.59 0 top
R6160  10K  [0201]  61.93,98.2 0 top
R6161  10K  [0201]  61.93,98.81 0 top
R6162  10K  [0201]  61.93,99.42 0 top
R6163  10K  [0201]  61.93,100.03 0 top
R6164  10K  [0201]  61.93,100.63 0 top
R6165  10K  [0201]  61.93,101.24 0 top
R6166  10K  [0201]  61.93,101.85 0 top
R6167  10K  [0201]  61.93,102.46 0 top
R6168  10K  [0201]  61.93,103.07 0 top
R6169  10K  [0201]  61.93,103.68 0 top
R6170  10K  [0201]  61.93,104.29 0 top
R6171  10K  [0201]  61.93,104.9 0 top
R6172  10K  [0201]  61.93,105.51 0 top
R6173  10K  [0201]  61.93,106.12 0 top
R6174  10K  [0201]  61.93,106.73 0 top
R6175  10K  [0201]  61.93,107.34 0 top
R6176  10K  [0201]  61.93,107.95 0 top
R6177  10K  [0201]  61.93,108.56 0 top
R6178  10K  [0201]  61.93,109.17 0 top
R6179  10K  [0201]  61.93,109.78 0 top
R6180  10K  [0201]  61.93,110.39 0 top
R6181  10K  [0201]  61.93,111 0 top
R6182  10K  [0201]  61.93,111.61 0 top
R6183  10K  [0201]  61.93,112.22 0 top
R6184  10K  [0201]  61.93,112.83 0 top
R6185  10K  [0201]  61.93,113.44 0 top
R6186  10K  [0201]  61.93,114.05 0 top
R6187  10K  [0201]  61.93,114.66 0 top
R6188  10K  [0201]  61.93,115.27 0 top
R6189  10K  [0201]  61.93,115.87 0 top
R6190  10K  [0201]  61.93,116.48 0 top
R6191  10K  [0201]  61.93,117.09 0 top
R6192  10K  [0201]  61.93,117.7 0 top
R6193  10K  [0201]  61.93,118.31 0 top
R6194  10K  [0201]  61.93,118.92 0 top
R6195  10K  [0201]  61.93,119.53 0 top
R6196  10K  [0201]  61.93,120.14 0 top
R6197  10K  [0201]  61.93,120.75 0 top
R6198  10K  [0201]  61.93,121.36 0 top
R6199  10K  [0201]  61.93,121.97 0 top
R6200  10K  [0201]  61.93,122.58 0 top
R6201  10K  [0201]  63.14,1.27 0 top
R6202  10K  [0201]  63.14,1.88 0 top
R6203  10K  [0201]  63.14,2.49 0 top
R6204  10K  [0201]  63.14,3.1 0 top
R6205  10K  [0201]  63.14,3.71 0 top
R6206  10K  [0201]  63.14,4.32 0 top
R6207  10K  [0201]  63.14,4.93 0 top
R6208  10K  [0201]  63.14,5.54 0 top
R6209  10K  [0201]  63.14,6.15 0 top
R6210  10K  [0201]  63.14,6.76 0 top
R6211  10K  [0201]  63.14,7.37 0 top
R6212  10K  [0201]  63.14,7.98 0 top
R6213  10K  [0201]  63.14,8.59 0 top
R6214  10K  [0201]  63.14,9.19 0 top
R6215  10K  [0201]  63.14,9.8 0 top
R6216  10K  [0201]  63.14,10.41 0 top
R6217  10K  [0201]  63.14,11.02 0 top
R6218  10K  [0201]  63.14,11.63 0 top
R6219  10K  [0201]  63.14,12.24 0 top
R6220  10K  [0201]  63.14,12.85 0 top
R6221  10K  [0201]  63.14,13.46 0 top
R6222  10K  [0201]  63.14,14.07 0 top
R6223  10K  [0201]  63.14,14.68 0 top
R6224  10K  [0201]  63.14,15.29 0 top
R6225  10K  [0201]  63.14,15.9 0 top
R6226  10K  [0201]  63.14,16.51 0 top
R6227  10K  [0201]  63.14,17.12 0 top
R6228  10K  [0201]  63.14,17.73 0 top
R6229  10K  [0201]  63.14,18.34 0 top
R6230  10K  [0201]  63.14,18.95 0 top
R6231  10K  [0201]  63.14,19.56 0 top
R6232  10K  [0201]  63.14,20.17 0 top
R6233  10K  [0201]  63.14,20.78 0 top
R6234  10K  [0201]  63.14,21.39 0 top
R6235  10K  [0201]  63.14,22 0 top
R6236  10K  [0201]  63.14,22.61 0 top
R6237  10K  [0201]  63.14,23.22 0 top
R6238  10K  [0201]  63.14,23.83 0 top
R6239  10K  [0201]  63.14,24.43 0 top
R6240  10K  [0201]  63.14,25.04 0 top
R6241  10K  [0201]  63.14,25.65 0 top
R6242  10K  [0201]  63.14,26.26 0 top
R6243  10K  [0201]  63.14,26.87 0 top
R6244  10K  [0201]  63.14,27.48 0 top
R6245  10K  [0201]  63.14,28.09 0 top
R6246  10K  [0201]  63.14,28.7 0 top
R6247  10K  [0201]  63.14,29.31 0 top
R6248  10K  [0201]  63.14,29.92 0 top
R6249  10K  [0201]  63.14,30.53 0 top
R6250  10K  [0201]  63.14,31.14 0 top
R6251  10K  [0201]  63.14,31.75 0 top
R6252  10K  [0201]  63.14,32.36 0 top
R6253  10K  [0201]  63.14,32.97 0 top
R6254  10K  [0201]  63.14,33.58 0 top
R6255  10K  [0201]  63.14,34.19 0 top
R6256  10K  [0201]  63.14,34.8 0 top
R6257  10K  [0201]  63.14,35.41 0 top
R6258  10K  [0201]  63.14,36.02 0 top
R6259  10K  [0201]  63.14,36.63 0 top
R6260  10K  [0201]  63.14,37.24 0 top
R6261  10K  [0201]  63.14,37.85 0 top
R6262  10K  [0201]  63.14,38.46 0 top
R6263  10K  [0201]  63.14,39.07 0 top
R6264  10K  [0201]  63.14,39.67 0 top
R6265  10K  [0201]  63.14,40.28 0 top
R6266  10K  [0201]  63.14,40.89 0 top
R6267  10K  [0201]  63.14,41.5 0 top
R6268  10K  [0201]  63.14,42.11 0 top
R6269  10K  [0201]  63.14,42.72 0 top
R6270  10K  [0201]  63.14,43.33 0 top
R6271  10K  [0201]  63.14,43.94 0 top
R6272  10K  [0201]  63.14,44.55 0 top
R6273  10K  [0201]  63.14,45.16 0 top
R6274  10K  [0201]  63.14,45.77 0 top
R6275  10K  [0201]  63.14,46.38 0 top
R6276  10K  [0201]  63.14,46.99 0 top
R6277  10K  [0201]  63.14,47.6 0 top
R6278  10K  [0201]  63.14,48.21 0 top
R6279  10K  [0201]  63.14,48.82 0 top
R6280  10K  [0201]  63.14,49.43 0 top
R6281  10K  [0201]  63.14,50.04 0 top
R6282  10K  [0201]  63.14,50.65 0 top
R6283  10K  [0201]  63.14,51.26 0 top
R6284  10K  [0201]  63.14,51.87 0 top
R6285  10K  [0201]  63.14,52.48 0 top
R6286  10K  [0201]  63.14,53.09 0 top
R6287  10K  [0201]  63.14,53.7 0 top
R6288  10K  [0201]  63.14,54.31 0 top
R6289  10K  [0201]  63.14,54.91 0 top
R6290  10K  [0201]  63.14,55.52 0 top
R6291  10K  [0201]  63.14,56.13 0 top
R6292  10K  [0201]  63.14,56.74 0 top
R6293  10K  [0201]  63.14,57.35 0 top
R6294  10K  [0201]  63.14,57.96 0 top
R6295  10K  [0201]  63.14,58.57 0 top
R6296  10K  [0201]  63.14,59.18 0 top
R6297  10K  [0201]  63.14,59.79 0 top
R6298  10K  [0201]  63.14,60.4 0 top
R6299  10K  [0201]  63.14,61.01 0 top
R6300  10K  [0201]  63.14,61.62 0 top
R6301  10K  [0201]  63.14,62.23 0 top
R6302  10K  [0201]  63.14,62.84 0 top
R6303  10K  [0201]  63.14,63.45 0 top
R6304  10K  [0201]  63.14,64.06 0 top
R6305  10K  [0201]  63.14,64.67 0 top
R6306  10K  [0201]  63.14,65.28 0 top
R6307  10K  [0201]  63.14,65.89 0 top
R6308  10K  [0201]  63.14,66.5 0 top
R6309  10K  [0201]  63.14,67.11 0 top
R6310  10K  [0201]  63.14,67.72 0 top
R6311  10K  [0201]  63.14,68.33 0 top
R6312  10K  [0201]  63.14,68.94 0 top
R6313  10K  [0201]  63.14,69.55 0 top
R6314  10K  [0201]  63.14,70.15 0 top
R6315  10K  [0201]  63.14,70.76 0 top
R6316  10K  [0201]  63.14,71.37 0 top
R6317  10K  [0201]  63.14,71.98 0 top
R6318  10K  [0201]  63.14,72.59 0 top
R6319  10K  [0201]  63.14,73.2 0 top
R6320  10K  [0201]  63.14,73.81 0 top
R6321  10K  [0201]  63.14,74.42 0 top
R6322  10K  [0201]  63.14,75.03 0 top
R6323  10K  [0201]  63.14,75.64 0 top
R6324  10K  [0201]  63.14,76.25 0 top
R6325  10K  [0201]  63.14,76.86 0 top
R6326  10K  [0201]  63.14,77.47 0 top
R6327  10K  [0201]  63.14,78.08 0 top
R6328  10K  [0201]  63.14,78.69 0 top
R6329  10K  [0201]  63.14,79.3 0 top
R6330  10K  [0201]  63.14,79.91 0 top
R6331  10K  [0201]  63.14,80.52 0 top
R6332  10K  [0201]  63.14,81.13 0 top
R6333  10K  [0201]  63.14,81.74 0 top
R6334  10K  [0201]  63.14,82.35 0 top
R6335  10K  [0201]  63.14,82.96 0 top
R6336  10K  [0201]  63.14,83.57 0 top
R6337  10K  [0201]  63.14,84.18 0 top
R6338  10K  [0201]  63.14,84.79 0 top
R6339  10K  [0201]  63.14,85.39 0 top
R6340  10K  [0201]  63.14,86 0 top
R6341  10K  [0201]  63.14,86.61 0 top
R6342  10K  [0201]  63.14,87.22 0 top
R6343  10K  [0201]  63.14,87.83 0 top
R6344  10K  [0201]  63.14,88.44 0 top
R6345  10K  [0201]  63.14,89.05 0 top
R6346  10K  [0201]  63.14,89.66 0 top
R6347  10K  [0201]  63.14,90.27 0 top
R6348  10K  [0201]  63.14,90.88 0 top
R6349  10K  [0201]  63.14,91.49 0 top
R6350  10K  [0201]  63.14,92.1 0 top
R6351  10K  [0201]  63.14,92.71 0 top
R6352  10K  [0201]  63.14,93.32 0 top
R6353  10K  [0201]  63.14,93.93 0 top
R6354  10K  [0201]  63.14,94.54 0 top
R6355  10K  [0201]  63.14,95.15 0 top
R6356  10K  [0201]  63.14,95.76 0 top
R6357  10K  [0201]  63.14,96.37 0 top
R6358  10K  [0201]  63.14,96.98 0 top
R6359  10K  [0201]  63.14,97.59 0 top
R6360  10K  [0201]  63.14,98.2 0 top
R6361  10K  [0201]  63.14,98.81 0 top
R6362  10K  [0201]  63.14,99.42 0 top
R6363  10K  [0201]  63.14,100.03 0 top
R6364  10K  [0201]  63.14,100.63 0 top
R6365  10K  [0201]  63.14,101.24 0 top
R6366  10K  [0201]  63.14,101.85 0 top
R6367  10K  [0201]  63.14,102.46 0 top
R6368  10K  [0201]  63.14,103.07 0 top
R6369  10K  [0201]  63.14,103.68 0 top
R6370  10K  [0201]  63.14,104.29 0 top
R6371  10K  [0201]  63.14,104.9 0 top
R6372  10K  [0201]  63.14,105.51 0 top
R6373  10K  [0201]  63.14,106.12 0 top
R6374  10K  [0201]  63.14,106.73 0 top
R6375  10K  [0201]  63.14,107.34 0 top
R6376  10K  [0201]  63.14,107.95 0 top
R6377  10K  [0201]  63.14,108.56 0 top
R6378  10K  [0201]  63.14,109.17 0 top
R6379  10K  [0201]  63.14,109.78 0 top
R6380  10K  [0201]  63.14,110.39 0 top
R6381  10K  [0201]  63.14,111 0 top
R6382  10K  [0201]  63.14,111.61 0 top
R6383  10K  [0201]  63.14,112.22 0 top
R6384  10K  [0201]  63.14,112.83 0 top
R6385  10K  [0201]  63.14,113.44 0 top
R6386  10K  [0201]  63.14,114.05 0 top
R6387  10K  [0201]  63.14,114.66 0 top
R6388  10K  [0201]  63.14,115.27 0 top
R6389  10K  [0201]  63.14,115.87 0 top
R6390  10K  [0201]  63.14,116.48 0 top
R6391  10K  [0201]  63.14,117.09 0 top
R6392  10K  [0201]  63.14,117.7 0 top
R6393  10K  [0201]  63.14,118.31 0 top
R6394  10K  [0201]  63.14,118.92 0 top
R6395  10K  [0201]  63.14,119.53 0 top
R6396  10K  [0201]  63.14,120.14 0 top
R6397  10K  [0201]  63.14,120.75 0 top
R6398  10K  [0201]  63.14,121.36 0 top
R6399  10K  [0201]  63.14,121.97 0 top
R6400  10K  [0201]  63.14,122.58 0 top
R6401  10K  [0201]  64.36,1.27 0 top
R6402  10K  [0201]  64.36,1.88 0 top
R6403  10K  [0201]  64.36,2.49 0 top
R6404  10K  [0201]  64.36,3.1 0 top
R6405  10K  [0201]  64.36,3.71 0 top
R6406  10K  [0201]  64.36,4.32 0 top
R6407  10K  [0201]  64.36,4.93 0 top
R6408  10K  [0201]  64.36,5.54 0 top
R6409  10K  [0201]  64.36,6.15 0 top
R6410  10K  [0201]  64.36,6.76 0 top
R6411  10K  [0201]  64.36,7.37 0 top
R6412  10K  [0201]  64.36,7.98 0 top
R6413  10K  [0201]  64.36,8.59 0 top
R6414  10K  [0201]  64.36,9.19 0 top
R6415  10K  [0201]  64.36,9.8 0 top
R6416  10K  [0201]  64.36,10.41 0 top
R6417  10K  [0201]  64.36,11.02 0 top
R6418  10K  [0201]  64.36,11.63 0 top
R6419  10K  [0201]  64.36,12.24 0 top
R6420  10K  [0201]  64.36,12.85 0 top
R6421  10K  [0201]  64.36,13.46 0 top
R6422  10K  [0201]  64.36,14.07 0 top
R6423  10K  [0201]  64.36,14.68 0 top
R6424  10K  [0201]  64.36,15.29 0 top
R6425  10K  [0201]  64.36,15.9 0 top
R6426  10K  [0201]  64.36,16.51 0 top
R6427  10K  [0201]  64.36,17.12 0 top
R6428  10K  [0201]  64.36,17.73 0 top
R6429  10K  [0201]  64.36,18.34 0 top
R6430  10K  [0201]  64.36,18.95 0 top
R6431  10K  [0201]  64.36,19.56 0 top
R6432  10K  [0201]  64.36,20.17 0 top
R6433  10K  [0201]  64.36,20.78 0 top
R6434  10K  [0201]  64.36,21.39 0 top
R6435  10K  [0201]  64.36,22 0 top
R6436  10K  [0201]  64.36,22.61 0 top
R6437  10K  [0201]  64.36,23.22 0 top
R6438  10K  [0201]  64.36,23.83 0 top
R6439  10K  [0201]  64.36,24.43 0 top
R6440  10K  [0201]  64.36,25.04 0 top
R6441  10K  [0201]  64.36,25.65 0 top
R6442  10K  [0201]  64.36,26.26 0 top
R6443  10K  [0201]  64.36,26.87 0 top
R6444  10K  [0201]  64.36,27.48 0 top
R6445  10K  [0201]  64.36,28.09 0 top
R6446  10K  [0201]  64.36,28.7 0 top
R6447  10K  [0201]  64.36,29.31 0 top
R6448  10K  [0201]  64.36,29.92 0 top
R6449  10K  [0201]  64.36,30.53 0 top
R6450  10K  [0201]  64.36,31.14 0 top
R6451  10K  [0201]  64.36,31.75 0 top
R6452  10K  [0201]  64.36,32.36 0 top
R6453  10K  [0201]  64.36,32.97 0 top
R6454  10K  [0201]  64.36,33.58 0 top
R6455  10K  [0201]  64.36,34.19 0 top
R6456  10K  [0201]  64.36,34.8 0 top
R6457  10K  [0201]  64.36,35.41 0 top
R6458  10K  [0201]  64.36,36.02 0 top
R6459  10K  [0201]  64.36,36.63 0 top
R6460  10K  [0201]  64.36,37.24 0 top
R6461  10K  [0201]  64.36,37.85 0 top
R6462  10K  [0201]  64.36,38.46 0 top
R6463  10K  [0201]  64.36,39.07 0 top
R6464  10K  [0201]  64.36,39.67 0 top
R6465  10K  [0201]  64.36,40.28 0 top
R6466  10K  [0201]  64.36,40.89 0 top
R6467  10K  [0201]  64.36,41.5 0 top
R6468  10K  [0201]  64.36,42.11 0 top
R6469  10K  [0201]  64.36,42.72 0 top
R6470  10K  [0201]  64.36,43.33 0 top
R6471  10K  [0201]  64.36,43.94 0 top
R6472  10K  [0201]  64.36,44.55 0 top
R6473  10K  [0201]  64.36,45.16 0 top
R6474  10K  [0201]  64.36,45.77 0 top
R6475  10K  [0201]  64.36,46.38 0 top
R6476  10K  [0201]  64.36,46.99 0 top
R6477  10K  [0201]  64.36,47.6 0 top
R6478  10K  [0201]  64.36,48.21 0 top
R6479  10K  [0201]  64.36,48.82 0 top
R6480  10K  [0201]  64.36,49.43 0 top
R6481  10K  [0201]  64.36,50.04 0 top
R6482  10K  [0201]  64.36,50.65 0 top
R6483  10K  [0201]  64.36,51.26 0 top
R6484  10K  [0201]  64.36,51.87 0 top
R6485  10K  [0201]  64.36,52.48 0 top
R6486  10K  [0201]  64.36,53.09 0 top
R6487  10K  [0201]  64.36,53.7 0 top
R6488  10K  [0201]  64.36,54.31 0 top
R6489  10K  [0201]  64.36,54.91 0 top
R6490  10K  [0201]  64.36,55.52 0 top
R6491  10K  [0201]  64.36,56.13 0 top
R6492  10K  [0201]  64.36,56.74 0 top
R6493  10K  [0201]  64.36,57.35 0 top
R6494  10K  [0201]  64.36,57.96 0 top
R6495  10K  [0201]  64.36,58.57 0 top
R6496  10K  [0201]  64.36,59.18 0 top
R6497  10K  [0201]  64.36,59.79 0 top
R6498  10K  [0201]  64.36,60.4 0 top
R6499  10K  [0201]  64.36,61.01 0 top
R6500  10K  [0201]  64.36,61.62 0 top
R6501  10K  [0201]  64.36,62.23 0 top
R6502  10K  [0201]  64.36,62.84 0 top
R6503  10K  [0201]  64.36,63.45 0 top
R6504  10K  [0201]  64.36,64.06 0 top
R6505  10K  [0201]  64.36,64.67 0 top
R6506  10K  [0201]  64.36,65.28 0 top
R6507  10K  [0201]  64.36,65.89 0 top
R6508  10K  [0201]  64.36,66.5 0 top
R6509  10K  [0201]  64.36,67.11 0 top
R6510  10K  [0201]  64.36,67.72 0 top
R6511  10K  [0201]  64.36,68.33 0 top
R6512  10K  [0201]  64.36,68.94 0 top
R6513  10K  [0201]  64.36,69.55 0 top
R6514  10K  [0201]  64.36,70.15 0 top
R6515  10K  [0201]  64.36,70.76 0 top
R6516  10K  [0201]  64.36,71.37 0 top
R6517  10K  [0201]  64.36,71.98 0 top
R6518  10K  [0201]  64.36,72.59 0 top
R6519  10K  [0201]  64.36,73.2 0 top
R6520  10K  [0201]  64.36,73.81 0 top
R6521  10K  [0201]  64.36,74.42 0 top
R6522  10K  [0201]  64.36,75.03 0 top
R6523  10K  [0201]  64.36,75.64 0 top
R6524  10K  [0201]  64.36,76.25 0 top
R6525  10K  [0201]  64.36,76.86 0 top
R6526  10K  [0201]  64.36,77.47 0 top
R6527  10K  [0201]  64.36,78.08 0 top
R6528  10K  [0201]  64.36,78.69 0 top
R6529  10K  [0201]  64.36,79.3 0 top
R6530  10K  [0201]  64.36,79.91 0 top
R6531  10K  [0201]  64.36,80.52 0 top
R6532  10K  [0201]  64.36,81.13 0 top
R6533  10K  [0201]  64.36,81.74 0 top
R6534  10K  [0201]  64.36,82.35 0 top
R6535  10K  [0201]  64.36,82.96 0 top
R6536  10K  [0201]  64.36,83.57 0 top
R6537  10K  [0201]  64.36,84.18 0 top
R6538  10K  [0201]  64.36,84.79 0 top
R6539  10K  [0201]  64.36,85.39 0 top
R6540  10K  [0201]  64.36,86 0 top
R6541  10K  [0201]  64.36,86.61 0 top
R6542  10K  [0201]  64.36,87.22 0 top
R6543  10K  [0201]  64.36,87.83 0 top
R6544  10K  [0201]  64.36,88.44 0 top
R6545  10K  [0201]  64.36,89.05 0 top
R6546  10K  [0201]  64.36,89.66 0 top
R6547  10K  [0201]  64.36,90.27 0 top
R6548  10K  [0201]  64.36,90.88 0 top
R6549  10K  [0201]  64.36,91.49 0 top
R6550  10K  [0201]  64.36,92.1 0 top
R6551  10K  [0201]  64.36,92.71 0 top